# Altium schematic sheet ZYNQ_US_SOC_PL_GTX.SchDoc (part 1 of 3)
size 419 x 296 mm
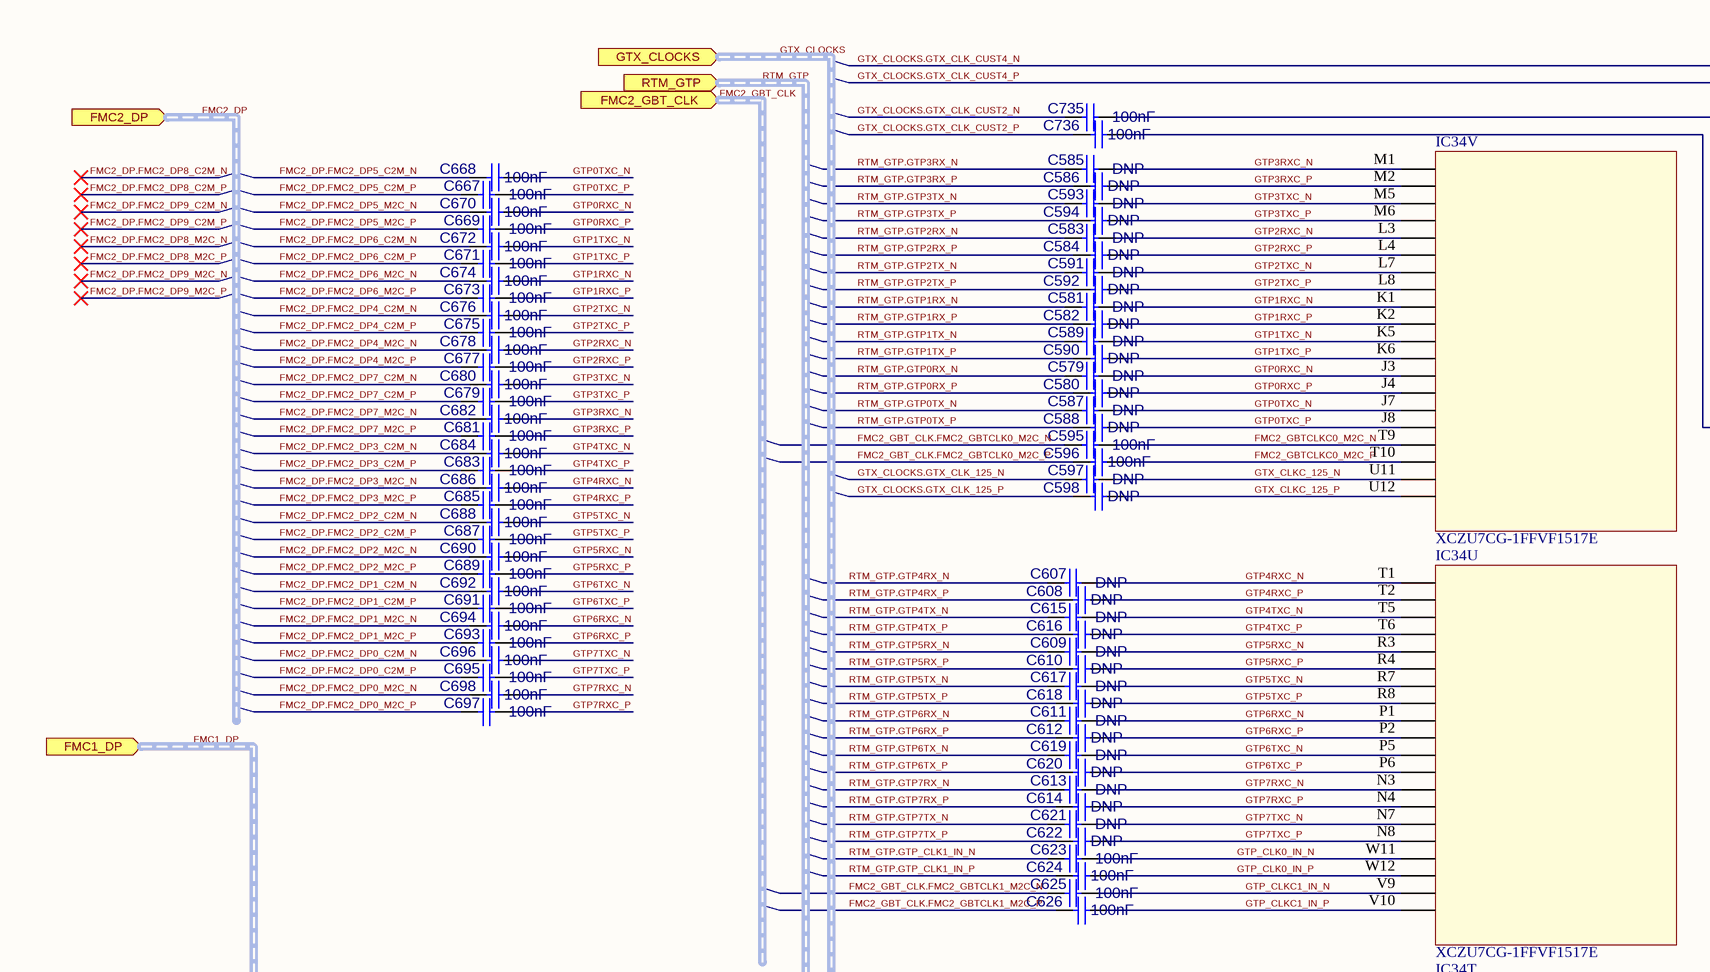
[diagram p0: ZYNQ_US_SOC_PL_GTX.SchDoc, top left]
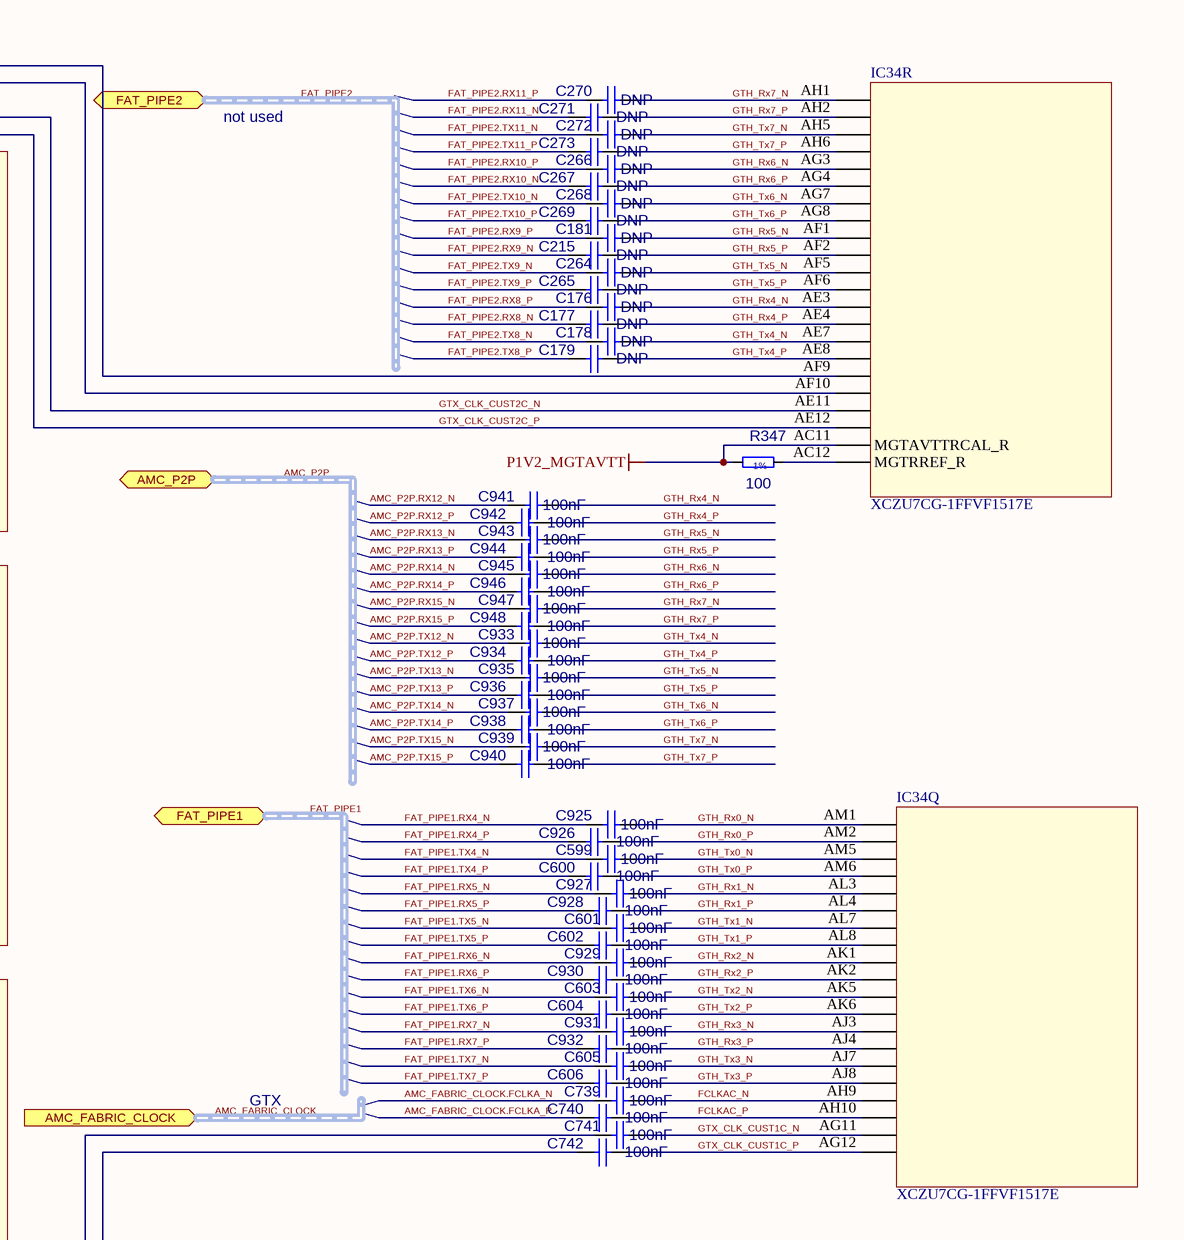
[diagram p1: ZYNQ_US_SOC_PL_GTX.SchDoc, top right]
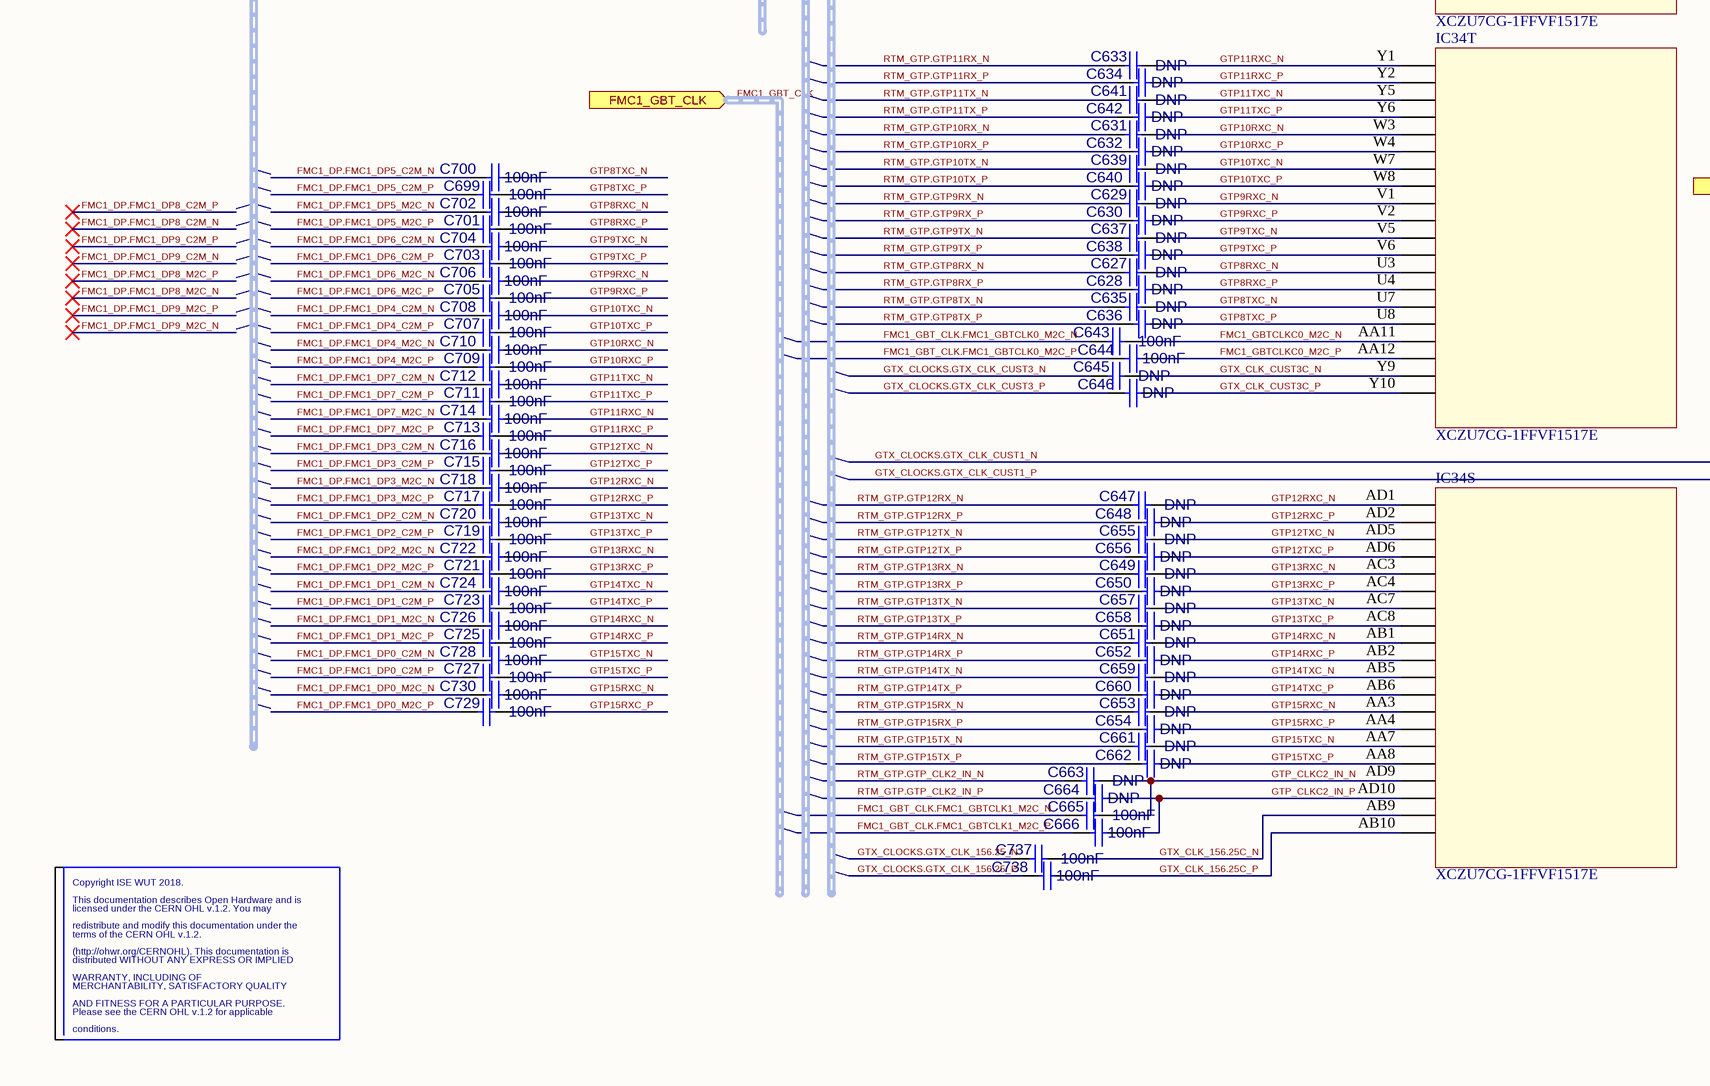
[diagram p2: ZYNQ_US_SOC_PL_GTX.SchDoc, bottom left]

## Parts
C176  value DNP  [CAPC0603X33N]  (hidden comment: Capacitor - non polarized CAPC0603X33N)
C177  value DNP  [CAPC0603X33N]  (hidden comment: Capacitor - non polarized CAPC0603X33N)
C178  value DNP  [CAPC0603X33N]  (hidden comment: Capacitor - non polarized CAPC0603X33N)
C179  value DNP  [CAPC0603X33N]  (hidden comment: Capacitor - non polarized CAPC0603X33N)
C181  value DNP  [CAPC0603X33N]  (hidden comment: Capacitor - non polarized CAPC0603X33N)
C215  value DNP  [CAPC0603X33N]  (hidden comment: Capacitor - non polarized CAPC0603X33N)
C264  value DNP  [CAPC0603X33N]  (hidden comment: Capacitor - non polarized CAPC0603X33N)
C265  value DNP  [CAPC0603X33N]  (hidden comment: Capacitor - non polarized CAPC0603X33N)
C266  value DNP  [CAPC0603X33N]  (hidden comment: Capacitor - non polarized CAPC0603X33N)
C267  value DNP  [CAPC0603X33N]  (hidden comment: Capacitor - non polarized CAPC0603X33N)
C268  value DNP  [CAPC0603X33N]  (hidden comment: Capacitor - non polarized CAPC0603X33N)
C269  value DNP  [CAPC0603X33N]  (hidden comment: Capacitor - non polarized CAPC0603X33N)
C270  value DNP  [CAPC0603X33N]  (hidden comment: Capacitor - non polarized CAPC0603X33N)
C271  value DNP  [CAPC0603X33N]  (hidden comment: Capacitor - non polarized CAPC0603X33N)
C272  value DNP  [CAPC0603X33N]  (hidden comment: Capacitor - non polarized CAPC0603X33N)
C273  value DNP  [CAPC0603X33N]  (hidden comment: Capacitor - non polarized CAPC0603X33N)
C579  value DNP  [CAPC0603X33N]  (hidden comment: Capacitor - non polarized CAPC0603X33N)
C580  value DNP  [CAPC0603X33N]  (hidden comment: Capacitor - non polarized CAPC0603X33N)
C581  value DNP  [CAPC0603X33N]  (hidden comment: Capacitor - non polarized CAPC0603X33N)
C582  value DNP  [CAPC0603X33N]  (hidden comment: Capacitor - non polarized CAPC0603X33N)
C583  value DNP  [CAPC0603X33N]  (hidden comment: Capacitor - non polarized CAPC0603X33N)
C584  value DNP  [CAPC0603X33N]  (hidden comment: Capacitor - non polarized CAPC0603X33N)
C585  value DNP  [CAPC0603X33N]  (hidden comment: Capacitor - non polarized CAPC0603X33N)
C586  value DNP  [CAPC0603X33N]  (hidden comment: Capacitor - non polarized CAPC0603X33N)
C587  value DNP  [CAPC0603X33N]  (hidden comment: Capacitor - non polarized CAPC0603X33N)
C588  value DNP  [CAPC0603X33N]  (hidden comment: Capacitor - non polarized CAPC0603X33N)
C589  value DNP  [CAPC0603X33N]  (hidden comment: Capacitor - non polarized CAPC0603X33N)
C590  value DNP  [CAPC0603X33N]  (hidden comment: Capacitor - non polarized CAPC0603X33N)
C591  value DNP  [CAPC0603X33N]  (hidden comment: Capacitor - non polarized CAPC0603X33N)
C592  value DNP  [CAPC0603X33N]  (hidden comment: Capacitor - non polarized CAPC0603X33N)
C593  value DNP  [CAPC0603X33N]  (hidden comment: Capacitor - non polarized CAPC0603X33N)
C594  value DNP  [CAPC0603X33N]  (hidden comment: Capacitor - non polarized CAPC0603X33N)
C595  value 100nF  [CAPC0603X33N]  (hidden comment: Capacitor - non polarized CAPC0603X33N)
C596  value 100nF  [CAPC0603X33N]  (hidden comment: Capacitor - non polarized CAPC0603X33N)
C597  value DNP  [CAPC0603X33N]  (hidden comment: Capacitor - non polarized CAPC0603X33N)
C598  value DNP  [CAPC0603X33N]  (hidden comment: Capacitor - non polarized CAPC0603X33N)
C599  value 100nF  [CAPC0603X33N]  (hidden comment: Capacitor - non polarized CAPC0603X33N)
C600  value 100nF  [CAPC0603X33N]  (hidden comment: Capacitor - non polarized CAPC0603X33N)
C601  value 100nF  [CAPC0603X33N]  (hidden comment: Capacitor - non polarized CAPC0603X33N)
C602  value 100nF  [CAPC0603X33N]  (hidden comment: Capacitor - non polarized CAPC0603X33N)
C603  value 100nF  [CAPC0603X33N]  (hidden comment: Capacitor - non polarized CAPC0603X33N)
C604  value 100nF  [CAPC0603X33N]  (hidden comment: Capacitor - non polarized CAPC0603X33N)
C605  value 100nF  [CAPC0603X33N]  (hidden comment: Capacitor - non polarized CAPC0603X33N)
C606  value 100nF  [CAPC0603X33N]  (hidden comment: Capacitor - non polarized CAPC0603X33N)
C607  value DNP  [CAPC0603X33N]  (hidden comment: Capacitor - non polarized CAPC0603X33N)
C608  value DNP  [CAPC0603X33N]  (hidden comment: Capacitor - non polarized CAPC0603X33N)
C609  value DNP  [CAPC0603X33N]  (hidden comment: Capacitor - non polarized CAPC0603X33N)
C610  value DNP  [CAPC0603X33N]  (hidden comment: Capacitor - non polarized CAPC0603X33N)
C611  value DNP  [CAPC0603X33N]  (hidden comment: Capacitor - non polarized CAPC0603X33N)
C612  value DNP  [CAPC0603X33N]  (hidden comment: Capacitor - non polarized CAPC0603X33N)
C613  value DNP  [CAPC0603X33N]  (hidden comment: Capacitor - non polarized CAPC0603X33N)
C614  value DNP  [CAPC0603X33N]  (hidden comment: Capacitor - non polarized CAPC0603X33N)
C615  value DNP  [CAPC0603X33N]  (hidden comment: Capacitor - non polarized CAPC0603X33N)
C616  value DNP  [CAPC0603X33N]  (hidden comment: Capacitor - non polarized CAPC0603X33N)
C617  value DNP  [CAPC0603X33N]  (hidden comment: Capacitor - non polarized CAPC0603X33N)
C618  value DNP  [CAPC0603X33N]  (hidden comment: Capacitor - non polarized CAPC0603X33N)
C619  value DNP  [CAPC0603X33N]  (hidden comment: Capacitor - non polarized CAPC0603X33N)
C620  value DNP  [CAPC0603X33N]  (hidden comment: Capacitor - non polarized CAPC0603X33N)
C621  value DNP  [CAPC0603X33N]  (hidden comment: Capacitor - non polarized CAPC0603X33N)
C622  value DNP  [CAPC0603X33N]  (hidden comment: Capacitor - non polarized CAPC0603X33N)
C623  value 100nF  [CAPC0603X33N]  (hidden comment: Capacitor - non polarized CAPC0603X33N)
C624  value 100nF  [CAPC0603X33N]  (hidden comment: Capacitor - non polarized CAPC0603X33N)
C625  value 100nF  [CAPC0603X33N]  (hidden comment: Capacitor - non polarized CAPC0603X33N)
C626  value 100nF  [CAPC0603X33N]  (hidden comment: Capacitor - non polarized CAPC0603X33N)
C627  value DNP  [CAPC0603X33N]  (hidden comment: Capacitor - non polarized CAPC0603X33N)
C628  value DNP  [CAPC0603X33N]  (hidden comment: Capacitor - non polarized CAPC0603X33N)
C629  value DNP  [CAPC0603X33N]  (hidden comment: Capacitor - non polarized CAPC0603X33N)
C630  value DNP  [CAPC0603X33N]  (hidden comment: Capacitor - non polarized CAPC0603X33N)
C631  value DNP  [CAPC0603X33N]  (hidden comment: Capacitor - non polarized CAPC0603X33N)
C632  value DNP  [CAPC0603X33N]  (hidden comment: Capacitor - non polarized CAPC0603X33N)
C633  value DNP  [CAPC0603X33N]  (hidden comment: Capacitor - non polarized CAPC0603X33N)
C634  value DNP  [CAPC0603X33N]  (hidden comment: Capacitor - non polarized CAPC0603X33N)
C635  value DNP  [CAPC0603X33N]  (hidden comment: Capacitor - non polarized CAPC0603X33N)
C636  value DNP  [CAPC0603X33N]  (hidden comment: Capacitor - non polarized CAPC0603X33N)
C637  value DNP  [CAPC0603X33N]  (hidden comment: Capacitor - non polarized CAPC0603X33N)
C638  value DNP  [CAPC0603X33N]  (hidden comment: Capacitor - non polarized CAPC0603X33N)
C639  value DNP  [CAPC0603X33N]  (hidden comment: Capacitor - non polarized CAPC0603X33N)
C640  value DNP  [CAPC0603X33N]  (hidden comment: Capacitor - non polarized CAPC0603X33N)
C641  value DNP  [CAPC0603X33N]  (hidden comment: Capacitor - non polarized CAPC0603X33N)
C642  value DNP  [CAPC0603X33N]  (hidden comment: Capacitor - non polarized CAPC0603X33N)
C643  value 100nF  [CAPC0603X33N]  (hidden comment: Capacitor - non polarized CAPC0603X33N)
C644  value 100nF  [CAPC0603X33N]  (hidden comment: Capacitor - non polarized CAPC0603X33N)
C645  value DNP  [CAPC0603X33N]  (hidden comment: Capacitor - non polarized CAPC0603X33N)
C646  value DNP  [CAPC0603X33N]  (hidden comment: Capacitor - non polarized CAPC0603X33N)
C647  value DNP  [CAPC0603X33N]  (hidden comment: Capacitor - non polarized CAPC0603X33N)
C648  value DNP  [CAPC0603X33N]  (hidden comment: Capacitor - non polarized CAPC0603X33N)
C649  value DNP  [CAPC0603X33N]  (hidden comment: Capacitor - non polarized CAPC0603X33N)
C650  value DNP  [CAPC0603X33N]  (hidden comment: Capacitor - non polarized CAPC0603X33N)
C651  value DNP  [CAPC0603X33N]  (hidden comment: Capacitor - non polarized CAPC0603X33N)
C652  value DNP  [CAPC0603X33N]  (hidden comment: Capacitor - non polarized CAPC0603X33N)
C653  value DNP  [CAPC0603X33N]  (hidden comment: Capacitor - non polarized CAPC0603X33N)
C654  value DNP  [CAPC0603X33N]  (hidden comment: Capacitor - non polarized CAPC0603X33N)
C655  value DNP  [CAPC0603X33N]  (hidden comment: Capacitor - non polarized CAPC0603X33N)
C656  value DNP  [CAPC0603X33N]  (hidden comment: Capacitor - non polarized CAPC0603X33N)
C657  value DNP  [CAPC0603X33N]  (hidden comment: Capacitor - non polarized CAPC0603X33N)
C658  value DNP  [CAPC0603X33N]  (hidden comment: Capacitor - non polarized CAPC0603X33N)
C659  value DNP  [CAPC0603X33N]  (hidden comment: Capacitor - non polarized CAPC0603X33N)
C660  value DNP  [CAPC0603X33N]  (hidden comment: Capacitor - non polarized CAPC0603X33N)
C661  value DNP  [CAPC0603X33N]  (hidden comment: Capacitor - non polarized CAPC0603X33N)
C662  value DNP  [CAPC0603X33N]  (hidden comment: Capacitor - non polarized CAPC0603X33N)
C663  value DNP  [CAPC0603X33N]  (hidden comment: Capacitor - non polarized CAPC0603X33N)
C664  value DNP  [CAPC0603X33N]  (hidden comment: Capacitor - non polarized CAPC0603X33N)
C665  value 100nF  [CAPC0603X33N]  (hidden comment: Capacitor - non polarized CAPC0603X33N)
C666  value 100nF  [CAPC0603X33N]  (hidden comment: Capacitor - non polarized CAPC0603X33N)
C667  value 100nF  [CAPC0603X33N]  (hidden comment: Capacitor - non polarized CAPC0603X33N)
C668  value 100nF  [CAPC0603X33N]  (hidden comment: Capacitor - non polarized CAPC0603X33N)
C669  value 100nF  [CAPC0603X33N]  (hidden comment: Capacitor - non polarized CAPC0603X33N)
C670  value 100nF  [CAPC0603X33N]  (hidden comment: Capacitor - non polarized CAPC0603X33N)
C671  value 100nF  [CAPC0603X33N]  (hidden comment: Capacitor - non polarized CAPC0603X33N)
C672  value 100nF  [CAPC0603X33N]  (hidden comment: Capacitor - non polarized CAPC0603X33N)
C673  value 100nF  [CAPC0603X33N]  (hidden comment: Capacitor - non polarized CAPC0603X33N)
C674  value 100nF  [CAPC0603X33N]  (hidden comment: Capacitor - non polarized CAPC0603X33N)
C675  value 100nF  [CAPC0603X33N]  (hidden comment: Capacitor - non polarized CAPC0603X33N)
C676  value 100nF  [CAPC0603X33N]  (hidden comment: Capacitor - non polarized CAPC0603X33N)
C677  value 100nF  [CAPC0603X33N]  (hidden comment: Capacitor - non polarized CAPC0603X33N)
C678  value 100nF  [CAPC0603X33N]  (hidden comment: Capacitor - non polarized CAPC0603X33N)
C679  value 100nF  [CAPC0603X33N]  (hidden comment: Capacitor - non polarized CAPC0603X33N)
C680  value 100nF  [CAPC0603X33N]  (hidden comment: Capacitor - non polarized CAPC0603X33N)
C681  value 100nF  [CAPC0603X33N]  (hidden comment: Capacitor - non polarized CAPC0603X33N)
C682  value 100nF  [CAPC0603X33N]  (hidden comment: Capacitor - non polarized CAPC0603X33N)
C683  value 100nF  [CAPC0603X33N]  (hidden comment: Capacitor - non polarized CAPC0603X33N)
C684  value 100nF  [CAPC0603X33N]  (hidden comment: Capacitor - non polarized CAPC0603X33N)
C685  value 100nF  [CAPC0603X33N]  (hidden comment: Capacitor - non polarized CAPC0603X33N)
C686  value 100nF  [CAPC0603X33N]  (hidden comment: Capacitor - non polarized CAPC0603X33N)
C687  value 100nF  [CAPC0603X33N]  (hidden comment: Capacitor - non polarized CAPC0603X33N)
C688  value 100nF  [CAPC0603X33N]  (hidden comment: Capacitor - non polarized CAPC0603X33N)
C689  value 100nF  [CAPC0603X33N]  (hidden comment: Capacitor - non polarized CAPC0603X33N)
C690  value 100nF  [CAPC0603X33N]  (hidden comment: Capacitor - non polarized CAPC0603X33N)
C691  value 100nF  [CAPC0603X33N]  (hidden comment: Capacitor - non polarized CAPC0603X33N)
C692  value 100nF  [CAPC0603X33N]  (hidden comment: Capacitor - non polarized CAPC0603X33N)
C693  value 100nF  [CAPC0603X33N]  (hidden comment: Capacitor - non polarized CAPC0603X33N)
C694  value 100nF  [CAPC0603X33N]  (hidden comment: Capacitor - non polarized CAPC0603X33N)
C695  value 100nF  [CAPC0603X33N]  (hidden comment: Capacitor - non polarized CAPC0603X33N)
C696  value 100nF  [CAPC0603X33N]  (hidden comment: Capacitor - non polarized CAPC0603X33N)
C697  value 100nF  [CAPC0603X33N]  (hidden comment: Capacitor - non polarized CAPC0603X33N)
C698  value 100nF  [CAPC0603X33N]  (hidden comment: Capacitor - non polarized CAPC0603X33N)
C699  value 100nF  [CAPC0603X33N]  (hidden comment: Capacitor - non polarized CAPC0603X33N)
C700  value 100nF  [CAPC0603X33N]  (hidden comment: Capacitor - non polarized CAPC0603X33N)
C701  value 100nF  [CAPC0603X33N]  (hidden comment: Capacitor - non polarized CAPC0603X33N)
C702  value 100nF  [CAPC0603X33N]  (hidden comment: Capacitor - non polarized CAPC0603X33N)
C703  value 100nF  [CAPC0603X33N]  (hidden comment: Capacitor - non polarized CAPC0603X33N)
C704  value 100nF  [CAPC0603X33N]  (hidden comment: Capacitor - non polarized CAPC0603X33N)
C705  value 100nF  [CAPC0603X33N]  (hidden comment: Capacitor - non polarized CAPC0603X33N)
C706  value 100nF  [CAPC0603X33N]  (hidden comment: Capacitor - non polarized CAPC0603X33N)
C707  value 100nF  [CAPC0603X33N]  (hidden comment: Capacitor - non polarized CAPC0603X33N)
C708  value 100nF  [CAPC0603X33N]  (hidden comment: Capacitor - non polarized CAPC0603X33N)
C709  value 100nF  [CAPC0603X33N]  (hidden comment: Capacitor - non polarized CAPC0603X33N)
C710  value 100nF  [CAPC0603X33N]  (hidden comment: Capacitor - non polarized CAPC0603X33N)
C711  value 100nF  [CAPC0603X33N]  (hidden comment: Capacitor - non polarized CAPC0603X33N)
C712  value 100nF  [CAPC0603X33N]  (hidden comment: Capacitor - non polarized CAPC0603X33N)
C713  value 100nF  [CAPC0603X33N]  (hidden comment: Capacitor - non polarized CAPC0603X33N)
C714  value 100nF  [CAPC0603X33N]  (hidden comment: Capacitor - non polarized CAPC0603X33N)
C715  value 100nF  [CAPC0603X33N]  (hidden comment: Capacitor - non polarized CAPC0603X33N)
C716  value 100nF  [CAPC0603X33N]  (hidden comment: Capacitor - non polarized CAPC0603X33N)
C717  value 100nF  [CAPC0603X33N]  (hidden comment: Capacitor - non polarized CAPC0603X33N)
C718  value 100nF  [CAPC0603X33N]  (hidden comment: Capacitor - non polarized CAPC0603X33N)
C719  value 100nF  [CAPC0603X33N]  (hidden comment: Capacitor - non polarized CAPC0603X33N)
C720  value 100nF  [CAPC0603X33N]  (hidden comment: Capacitor - non polarized CAPC0603X33N)
C721  value 100nF  [CAPC0603X33N]  (hidden comment: Capacitor - non polarized CAPC0603X33N)
C722  value 100nF  [CAPC0603X33N]  (hidden comment: Capacitor - non polarized CAPC0603X33N)
C723  value 100nF  [CAPC0603X33N]  (hidden comment: Capacitor - non polarized CAPC0603X33N)
C724  value 100nF  [CAPC0603X33N]  (hidden comment: Capacitor - non polarized CAPC0603X33N)
C725  value 100nF  [CAPC0603X33N]  (hidden comment: Capacitor - non polarized CAPC0603X33N)
C726  value 100nF  [CAPC0603X33N]  (hidden comment: Capacitor - non polarized CAPC0603X33N)
C727  value 100nF  [CAPC0603X33N]  (hidden comment: Capacitor - non polarized CAPC0603X33N)
C728  value 100nF  [CAPC0603X33N]  (hidden comment: Capacitor - non polarized CAPC0603X33N)
C729  value 100nF  [CAPC0603X33N]  (hidden comment: Capacitor - non polarized CAPC0603X33N)
C730  value 100nF  [CAPC0603X33N]  (hidden comment: Capacitor - non polarized CAPC0603X33N)
C735  value 100nF  [CAPC0603X33N]  (hidden comment: Capacitor - non polarized CAPC0603X33N)
C736  value 100nF  [CAPC0603X33N]  (hidden comment: Capacitor - non polarized CAPC0603X33N)
C737  value 100nF  [CAPC0603X33N]  (hidden comment: Capacitor - non polarized CAPC0603X33N)
C738  value 100nF  [CAPC0603X33N]  (hidden comment: Capacitor - non polarized CAPC0603X33N)
C739  value 100nF  [CAPC0603X33N]  (hidden comment: Capacitor - non polarized CAPC0603X33N)
C740  value 100nF  [CAPC0603X33N]  (hidden comment: Capacitor - non polarized CAPC0603X33N)
C741  value 100nF  [CAPC0603X33N]  (hidden comment: Capacitor - non polarized CAPC0603X33N)
C742  value 100nF  [CAPC0603X33N]  (hidden comment: Capacitor - non polarized CAPC0603X33N)
C925  value 100nF  [CAPC0603X33N]  (hidden comment: Capacitor - non polarized CAPC0603X33N)
C926  value 100nF  [CAPC0603X33N]  (hidden comment: Capacitor - non polarized CAPC0603X33N)
C927  value 100nF  [CAPC0603X33N]  (hidden comment: Capacitor - non polarized CAPC0603X33N)
C928  value 100nF  [CAPC0603X33N]  (hidden comment: Capacitor - non polarized CAPC0603X33N)
C929  value 100nF  [CAPC0603X33N]  (hidden comment: Capacitor - non polarized CAPC0603X33N)
C930  value 100nF  [CAPC0603X33N]  (hidden comment: Capacitor - non polarized CAPC0603X33N)
C931  value 100nF  [CAPC0603X33N]  (hidden comment: Capacitor - non polarized CAPC0603X33N)
C932  value 100nF  [CAPC0603X33N]  (hidden comment: Capacitor - non polarized CAPC0603X33N)
C933  value 100nF  [CAPC0603X33N]  (hidden comment: Capacitor - non polarized CAPC0603X33N)
C934  value 100nF  [CAPC0603X33N]  (hidden comment: Capacitor - non polarized CAPC0603X33N)
C935  value 100nF  [CAPC0603X33N]  (hidden comment: Capacitor - non polarized CAPC0603X33N)
C936  value 100nF  [CAPC0603X33N]  (hidden comment: Capacitor - non polarized CAPC0603X33N)
C937  value 100nF  [CAPC0603X33N]  (hidden comment: Capacitor - non polarized CAPC0603X33N)
C938  value 100nF  [CAPC0603X33N]  (hidden comment: Capacitor - non polarized CAPC0603X33N)
C939  value 100nF  [CAPC0603X33N]  (hidden comment: Capacitor - non polarized CAPC0603X33N)
C940  value 100nF  [CAPC0603X33N]  (hidden comment: Capacitor - non polarized CAPC0603X33N)
C941  value 100nF  [CAPC0603X33N]  (hidden comment: Capacitor - non polarized CAPC0603X33N)
C942  value 100nF  [CAPC0603X33N]  (hidden comment: Capacitor - non polarized CAPC0603X33N)
C943  value 100nF  [CAPC0603X33N]  (hidden comment: Capacitor - non polarized CAPC0603X33N)
C944  value 100nF  [CAPC0603X33N]  (hidden comment: Capacitor - non polarized CAPC0603X33N)
C945  value 100nF  [CAPC0603X33N]  (hidden comment: Capacitor - non polarized CAPC0603X33N)
C946  value 100nF  [CAPC0603X33N]  (hidden comment: Capacitor - non polarized CAPC0603X33N)
C947  value 100nF  [CAPC0603X33N]  (hidden comment: Capacitor - non polarized CAPC0603X33N)
C948  value 100nF  [CAPC0603X33N]  (hidden comment: Capacitor - non polarized CAPC0603X33N)
IC34  XCZU7CG-1FFVF1517E  (parts Q,R,S,T,U,V of 26)
R347  value 100  (hidden comment: Resistor - 1% RESC1005X40N)

## Ports
AMC_FABRIC_CLOCK (in, harness AMC_FABRIC_CLOCK), AMC_P2P (bidir, harness AMC_P2P), FAT_PIPE1 (bidir, harness FAT_PIPE1), FAT_PIPE2 (bidir, harness FAT_PIPE2), FMC1_DP (in, harness FMC1_DP), FMC1_GBT_CLK (in, harness FMC1_GBT_CLK), FMC2_DP (in, harness FMC2_DP), FMC2_GBT_CLK (in, harness FMC2_GBT_CLK), GTX_CLOCKS (in, harness GTX_CLOCKS), RTM_GTP (in, harness RTM_GTP)

## Nets
P1V2_MGTAVTT: IC34.AC11(MGTAVTTRCAL_R) R347.1
AMC_FABRIC_CLOCK.FCLKA_N: C739.1
AMC_FABRIC_CLOCK.FCLKA_P: C740.1
AMC_P2P.RX12_N: C941.1
AMC_P2P.RX12_P: C942.1
AMC_P2P.RX13_N: C943.1
AMC_P2P.RX13_P: C944.1
AMC_P2P.RX14_N: C945.1
AMC_P2P.RX14_P: C946.1
AMC_P2P.RX15_N: C947.1
AMC_P2P.RX15_P: C948.1
AMC_P2P.TX12_N: C933.1
AMC_P2P.TX12_P: C934.1
AMC_P2P.TX13_N: C935.1
AMC_P2P.TX13_P: C936.1
AMC_P2P.TX14_N: C937.1
AMC_P2P.TX14_P: C938.1
AMC_P2P.TX15_N: C939.1
AMC_P2P.TX15_P: C940.1
FAT_PIPE1.RX4_N: C925.1
FAT_PIPE1.RX4_P: C926.1
FAT_PIPE1.RX5_N: C927.1
FAT_PIPE1.RX5_P: C928.1
FAT_PIPE1.RX6_N: C929.1
FAT_PIPE1.RX6_P: C930.1
FAT_PIPE1.RX7_N: C931.1
FAT_PIPE1.RX7_P: C932.1
FAT_PIPE1.TX4_N: C599.1
FAT_PIPE1.TX4_P: C600.1
FAT_PIPE1.TX5_N: C601.1
FAT_PIPE1.TX5_P: C602.1
FAT_PIPE1.TX6_N: C603.1
FAT_PIPE1.TX6_P: C604.1
FAT_PIPE1.TX7_N: C605.1
FAT_PIPE1.TX7_P: C606.1
FAT_PIPE2.RX8_N: C177.1
FAT_PIPE2.RX8_P: C176.1
FAT_PIPE2.RX9_N: C215.1
FAT_PIPE2.RX9_P: C181.1
FAT_PIPE2.RX10_N: C267.1
FAT_PIPE2.RX10_P: C266.1
FAT_PIPE2.RX11_N: C271.1
FAT_PIPE2.RX11_P: C270.1
FAT_PIPE2.TX8_N: C178.1
FAT_PIPE2.TX8_P: C179.1
FAT_PIPE2.TX9_N: C264.1
FAT_PIPE2.TX9_P: C265.1
FAT_PIPE2.TX10_N: C268.1
FAT_PIPE2.TX10_P: C269.1
FAT_PIPE2.TX11_N: C272.1
FAT_PIPE2.TX11_P: C273.1
FCLKAC_N: C739.2 IC34.AH9(GTHE4_COMMON_X0Y0_3)
FCLKAC_P: C740.2 IC34.AH10(GTHE4_COMMON_X0Y0_2)
FMC1_DP.FMC1_DP0_C2M_N: C728.1
FMC1_DP.FMC1_DP0_C2M_P: C727.1
FMC1_DP.FMC1_DP0_M2C_N: C730.1
FMC1_DP.FMC1_DP0_M2C_P: C729.1
FMC1_DP.FMC1_DP1_C2M_N: C724.1
FMC1_DP.FMC1_DP1_C2M_P: C723.1
FMC1_DP.FMC1_DP1_M2C_N: C726.1
FMC1_DP.FMC1_DP1_M2C_P: C725.1
FMC1_DP.FMC1_DP2_C2M_N: C720.1
FMC1_DP.FMC1_DP2_C2M_P: C719.1
FMC1_DP.FMC1_DP2_M2C_N: C722.1
FMC1_DP.FMC1_DP2_M2C_P: C721.1
FMC1_DP.FMC1_DP3_C2M_N: C716.1
FMC1_DP.FMC1_DP3_C2M_P: C715.1
FMC1_DP.FMC1_DP3_M2C_N: C718.1
FMC1_DP.FMC1_DP3_M2C_P: C717.1
FMC1_DP.FMC1_DP4_C2M_N: C708.1
FMC1_DP.FMC1_DP4_C2M_P: C707.1
FMC1_DP.FMC1_DP4_M2C_N: C710.1
FMC1_DP.FMC1_DP4_M2C_P: C709.1
FMC1_DP.FMC1_DP5_C2M_N: C700.1
FMC1_DP.FMC1_DP5_C2M_P: C699.1
FMC1_DP.FMC1_DP5_M2C_N: C702.1
FMC1_DP.FMC1_DP5_M2C_P: C701.1
FMC1_DP.FMC1_DP6_C2M_N: C704.1
FMC1_DP.FMC1_DP6_C2M_P: C703.1
FMC1_DP.FMC1_DP6_M2C_N: C706.1
FMC1_DP.FMC1_DP6_M2C_P: C705.1
FMC1_DP.FMC1_DP7_C2M_N: C712.1
FMC1_DP.FMC1_DP7_C2M_P: C711.1
FMC1_DP.FMC1_DP7_M2C_N: C714.1
FMC1_DP.FMC1_DP7_M2C_P: C713.1
FMC1_GBT_CLK.FMC1_GBTCLK0_M2C_N: C643.1
FMC1_GBT_CLK.FMC1_GBTCLK0_M2C_P: C644.1
FMC1_GBT_CLK.FMC1_GBTCLK1_M2C_N: C665.1
FMC1_GBT_CLK.FMC1_GBTCLK1_M2C_P: C666.1
FMC1_GBTCLKC0_M2C_N: C643.2 IC34.AA11(GTHE4_COMMON_X0Y3)
FMC1_GBTCLKC0_M2C_P: C644.2 IC34.AA12(GTHE4_COMMON_X0Y3_1)
FMC2_DP.FMC2_DP0_C2M_N: C696.1
FMC2_DP.FMC2_DP0_C2M_P: C695.1
FMC2_DP.FMC2_DP0_M2C_N: C698.1
FMC2_DP.FMC2_DP0_M2C_P: C697.1
FMC2_DP.FMC2_DP1_C2M_N: C692.1
FMC2_DP.FMC2_DP1_C2M_P: C691.1
FMC2_DP.FMC2_DP1_M2C_N: C694.1
FMC2_DP.FMC2_DP1_M2C_P: C693.1
FMC2_DP.FMC2_DP2_C2M_N: C688.1
FMC2_DP.FMC2_DP2_C2M_P: C687.1
FMC2_DP.FMC2_DP2_M2C_N: C690.1
FMC2_DP.FMC2_DP2_M2C_P: C689.1
FMC2_DP.FMC2_DP3_C2M_N: C684.1
FMC2_DP.FMC2_DP3_C2M_P: C683.1
FMC2_DP.FMC2_DP3_M2C_N: C686.1
FMC2_DP.FMC2_DP3_M2C_P: C685.1
FMC2_DP.FMC2_DP4_C2M_N: C676.1
FMC2_DP.FMC2_DP4_C2M_P: C675.1
FMC2_DP.FMC2_DP4_M2C_N: C678.1
FMC2_DP.FMC2_DP4_M2C_P: C677.1
FMC2_DP.FMC2_DP5_C2M_N: C668.1
FMC2_DP.FMC2_DP5_C2M_P: C667.1
FMC2_DP.FMC2_DP5_M2C_N: C670.1
FMC2_DP.FMC2_DP5_M2C_P: C669.1
FMC2_DP.FMC2_DP6_C2M_N: C672.1
FMC2_DP.FMC2_DP6_C2M_P: C671.1
FMC2_DP.FMC2_DP6_M2C_N: C674.1
FMC2_DP.FMC2_DP6_M2C_P: C673.1
FMC2_DP.FMC2_DP7_C2M_N: C680.1
FMC2_DP.FMC2_DP7_C2M_P: C679.1
FMC2_DP.FMC2_DP7_M2C_N: C682.1
FMC2_DP.FMC2_DP7_M2C_P: C681.1
FMC2_GBT_CLK.FMC2_GBTCLK0_M2C_N: C595.1
FMC2_GBT_CLK.FMC2_GBTCLK0_M2C_P: C596.1
FMC2_GBT_CLK.FMC2_GBTCLK1_M2C_N: C625.1
FMC2_GBT_CLK.FMC2_GBTCLK1_M2C_P: C626.1
FMC2_GBTCLKC0_M2C_N: C595.2 IC34.T9(GTHE4_COMMON_X0Y5_1)
FMC2_GBTCLKC0_M2C_P: C596.2 IC34.T10(GTHE4_COMMON_X0Y5)
GTH_Rx0_N: C925.2 IC34.AM1(GTHE4_CHANNEL_X0Y0)
GTH_Rx0_P: C926.2 IC34.AM2(GTHE4_CHANNEL_X0Y0_1)
GTH_Rx1_N: C927.2 IC34.AL3(GTHE4_CHANNEL_X0Y1)
GTH_Rx1_P: C928.2 IC34.AL4(GTHE4_CHANNEL_X0Y1_1)
GTH_Rx2_N: C929.2 IC34.AK1(GTHE4_CHANNEL_X0Y2)
GTH_Rx2_P: C930.2 IC34.AK2(GTHE4_CHANNEL_X0Y2_1)
GTH_Rx3_N: C931.2 IC34.AJ3(GTHE4_CHANNEL_X0Y3)
GTH_Rx3_P: C932.2 IC34.AJ4(GTHE4_CHANNEL_X0Y3_1)
GTH_Rx4_N: C176.2 C941.2 IC34.AE3(GTHE4_CHANNEL_X0Y7)
GTH_Rx4_P: C177.2 C942.2 IC34.AE4(GTHE4_CHANNEL_X0Y7_1)
GTH_Rx5_N: C181.2 C943.2 IC34.AF1(GTHE4_CHANNEL_X0Y6)
GTH_Rx5_P: C215.2 C944.2 IC34.AF2(GTHE4_CHANNEL_X0Y6_1)
GTH_Rx6_N: C266.2 C945.2 IC34.AG3(GTHE4_CHANNEL_X0Y5)
GTH_Rx6_P: C267.2 C946.2 IC34.AG4(GTHE4_CHANNEL_X0Y5_1)
GTH_Rx7_N: C270.2 C947.2 IC34.AH1(GTHE4_CHANNEL_X0Y4)
GTH_Rx7_P: C271.2 C948.2 IC34.AH2(GTHE4_CHANNEL_X0Y4_1)
GTH_Tx0_N: C599.2 IC34.AM5(GTHE4_CHANNEL_X0Y0_2)
GTH_Tx0_P: C600.2 IC34.AM6(GTHE4_CHANNEL_X0Y0_3)
GTH_Tx1_N: C601.2 IC34.AL7(GTHE4_CHANNEL_X0Y1_2)
GTH_Tx1_P: C602.2 IC34.AL8(GTHE4_CHANNEL_X0Y1_3)
GTH_Tx2_N: C603.2 IC34.AK5(GTHE4_CHANNEL_X0Y2_2)
GTH_Tx2_P: C604.2 IC34.AK6(GTHE4_CHANNEL_X0Y2_3)
GTH_Tx3_N: C605.2 IC34.AJ7(GTHE4_CHANNEL_X0Y3_2)
GTH_Tx3_P: C606.2 IC34.AJ8(GTHE4_CHANNEL_X0Y3_3)
GTH_Tx4_N: C178.2 C933.2 IC34.AE7(GTHE4_CHANNEL_X0Y7_2)
GTH_Tx4_P: C179.2 C934.2 IC34.AE8(GTHE4_CHANNEL_X0Y7_3)
GTH_Tx5_N: C264.2 C935.2 IC34.AF5(GTHE4_CHANNEL_X0Y6_2)
GTH_Tx5_P: C265.2 C936.2 IC34.AF6(GTHE4_CHANNEL_X0Y6_3)
GTH_Tx6_N: C268.2 C937.2 IC34.AG7(GTHE4_CHANNEL_X0Y5_2)
GTH_Tx6_P: C269.2 C938.2 IC34.AG8(GTHE4_CHANNEL_X0Y5_3)
GTH_Tx7_N: C272.2 C939.2 IC34.AH5(GTHE4_CHANNEL_X0Y4_2)
GTH_Tx7_P: C273.2 C940.2 IC34.AH6(GTHE4_CHANNEL_X0Y4_3)
GTP0RXC_N: C579.2 C670.2 IC34.J3(GTHE4_CHANNEL_X0Y23)
GTP0RXC_P: C580.2 C669.2 IC34.J4(GTHE4_CHANNEL_X0Y23_1)
GTP0TXC_N: C587.2 C668.2 IC34.J7(GTHE4_CHANNEL_X0Y23_2)
GTP0TXC_P: C588.2 C667.2 IC34.J8(GTHE4_CHANNEL_X0Y23_3)
GTP1RXC_N: C581.2 C674.2 IC34.K1(GTHE4_CHANNEL_X0Y22)
GTP1RXC_P: C582.2 C673.2 IC34.K2(GTHE4_CHANNEL_X0Y22_1)
GTP1TXC_N: C589.2 C672.2 IC34.K5(GTHE4_CHANNEL_X0Y22_2)
GTP1TXC_P: C590.2 C671.2 IC34.K6(GTHE4_CHANNEL_X0Y22_3)
GTP2RXC_N: C583.2 C678.2 IC34.L3(GTHE4_CHANNEL_X0Y21)
GTP2RXC_P: C584.2 C677.2 IC34.L4(GTHE4_CHANNEL_X0Y21_1)
GTP2TXC_N: C591.2 C676.2 IC34.L7(GTHE4_CHANNEL_X0Y21_2)
GTP2TXC_P: C592.2 C675.2 IC34.L8(GTHE4_CHANNEL_X0Y21_3)
GTP3RXC_N: C585.2 C682.2 IC34.M1(GTHE4_CHANNEL_X0Y20)
GTP3RXC_P: C586.2 C681.2 IC34.M2(GTHE4_CHANNEL_X0Y20_1)
GTP3TXC_N: C593.2 C680.2 IC34.M5(GTHE4_CHANNEL_X0Y20_2)
GTP3TXC_P: C594.2 C679.2 IC34.M6(GTHE4_CHANNEL_X0Y20_3)
GTP4RXC_N: C607.2 C686.2 IC34.T1(GTHE4_CHANNEL_X0Y16)
GTP4RXC_P: C608.2 C685.2 IC34.T2(GTHE4_CHANNEL_X0Y16_1)
GTP4TXC_N: C615.2 C684.2 IC34.T5(GTHE4_CHANNEL_X0Y16_2)
GTP4TXC_P: C616.2 C683.2 IC34.T6(GTHE4_CHANNEL_X0Y16_3)
GTP5RXC_N: C609.2 C690.2 IC34.R3(GTHE4_CHANNEL_X0Y17)
GTP5RXC_P: C610.2 C689.2 IC34.R4(GTHE4_CHANNEL_X0Y17_1)
GTP5TXC_N: C617.2 C688.2 IC34.R7(GTHE4_CHANNEL_X0Y17_2)
GTP5TXC_P: C618.2 C687.2 IC34.R8(GTHE4_CHANNEL_X0Y17_3)
GTP6RXC_N: C611.2 C694.2 IC34.P1(GTHE4_CHANNEL_X0Y18)
GTP6RXC_P: C612.2 C693.2 IC34.P2(GTHE4_CHANNEL_X0Y18_1)
GTP6TXC_N: C619.2 C692.2 IC34.P5(GTHE4_CHANNEL_X0Y18_2)
GTP6TXC_P: C620.2 C691.2 IC34.P6(GTHE4_CHANNEL_X0Y18_3)
GTP7RXC_N: C613.2 C698.2 IC34.N3(GTHE4_CHANNEL_X0Y19)
GTP7RXC_P: C614.2 C697.2 IC34.N4(GTHE4_CHANNEL_X0Y19_1)
GTP7TXC_N: C621.2 C696.2 IC34.N7(GTHE4_CHANNEL_X0Y19_2)
GTP7TXC_P: C622.2 C695.2 IC34.N8(GTHE4_CHANNEL_X0Y19_3)
GTP8RXC_N: C627.2 C702.2 IC34.U3(GTHE4_CHANNEL_X0Y15)
GTP8RXC_P: C628.2 C701.2 IC34.U4(GTHE4_CHANNEL_X0Y15_1)
GTP8TXC_N: C635.2 C700.2 IC34.U7(GTHE4_CHANNEL_X0Y15_2)
GTP8TXC_P: C636.2 C699.2 IC34.U8(GTHE4_CHANNEL_X0Y15_3)
GTP9RXC_N: C629.2 C706.2 IC34.V1(GTHE4_CHANNEL_X0Y14)
GTP9RXC_P: C630.2 C705.2 IC34.V2(GTHE4_CHANNEL_X0Y14_1)
GTP9TXC_N: C637.2 C704.2 IC34.V5(GTHE4_CHANNEL_X0Y14_2)
GTP9TXC_P: C638.2 C703.2 IC34.V6(GTHE4_CHANNEL_X0Y14_3)
GTP10RXC_N: C631.2 C710.2 IC34.W3(GTHE4_CHANNEL_X0Y13)
GTP10RXC_P: C632.2 C709.2 IC34.W4(GTHE4_CHANNEL_X0Y13_1)
GTP10TXC_N: C639.2 C708.2 IC34.W7(GTHE4_CHANNEL_X0Y13_2)
GTP10TXC_P: C640.2 C707.2 IC34.W8(GTHE4_CHANNEL_X0Y13_3)
GTP11RXC_N: C633.2 C714.2 IC34.Y1(GTHE4_CHANNEL_X0Y12)
GTP11RXC_P: C634.2 C713.2 IC34.Y2(GTHE4_CHANNEL_X0Y12_1)
GTP11TXC_N: C641.2 C712.2 IC34.Y5(GTHE4_CHANNEL_X0Y12_2)
GTP11TXC_P: C642.2 C711.2 IC34.Y6(GTHE4_CHANNEL_X0Y12_3)
GTP12RXC_N: C647.2 C718.2 IC34.AD1(GTHE4_CHANNEL_X0Y8)
GTP12RXC_P: C648.2 C717.2 IC34.AD2(GTHE4_CHANNEL_X0Y8_1)
GTP12TXC_N: C655.2 C716.2 IC34.AD5(GTHE4_CHANNEL_X0Y8_2)
GTP12TXC_P: C656.2 C715.2 IC34.AD6(GTHE4_CHANNEL_X0Y8_3)
GTP13RXC_N: C649.2 C722.2 IC34.AC3(GTHE4_CHANNEL_X0Y9)
GTP13RXC_P: C650.2 C721.2 IC34.AC4(GTHE4_CHANNEL_X0Y9_1)
GTP13TXC_N: C657.2 C720.2 IC34.AC7(GTHE4_CHANNEL_X0Y9_2)
GTP13TXC_P: C658.2 C719.2 IC34.AC8(GTHE4_CHANNEL_X0Y9_3)
GTP14RXC_N: C651.2 C726.2 IC34.AB1(GTHE4_CHANNEL_X0Y10)
GTP14RXC_P: C652.2 C725.2 IC34.AB2(GTHE4_CHANNEL_X0Y10_1)
GTP14TXC_N: C659.2 C724.2 IC34.AB5(GTHE4_CHANNEL_X0Y10_2)
GTP14TXC_P: C660.2 C723.2 IC34.AB6(GTHE4_CHANNEL_X0Y10_3)
GTP15RXC_N: C653.2 C730.2 IC34.AA3(GTHE4_CHANNEL_X0Y11)
GTP15RXC_P: C654.2 C729.2 IC34.AA4(GTHE4_CHANNEL_X0Y11_1)
GTP15TXC_N: C661.2 C728.2 IC34.AA7(GTHE4_CHANNEL_X0Y11_2)
GTP15TXC_P: C662.2 C727.2 IC34.AA8(GTHE4_CHANNEL_X0Y11_3)
GTP_CLK0_IN_N: C623.2 IC34.W11(GTHE4_COMMON_X0Y4_2)
GTP_CLK0_IN_P: C624.2 IC34.W12(GTHE4_COMMON_X0Y4_3)
GTP_CLKC1_IN_N: C625.2 IC34.V9(GTHE4_COMMON_X0Y4_1)
GTP_CLKC1_IN_P: C626.2 IC34.V10(GTHE4_COMMON_X0Y4)
GTP_CLKC2_IN_N: C663.2 C665.2 IC34.AD9(GTHE4_COMMON_X0Y2_3)
GTP_CLKC2_IN_P: C664.2 C666.2 IC34.AD10(GTHE4_COMMON_X0Y2_2)
GTX_CLK_156.25C_N: C737.2 IC34.AB9(GTHE4_COMMON_X0Y2_1)
GTX_CLK_156.25C_P: C738.2 IC34.AB10(GTHE4_COMMON_X0Y2)
GTX_CLK_CUST1C_N: C741.2 IC34.AG11(GTHE4_COMMON_X0Y0)
GTX_CLK_CUST1C_P: C742.2 IC34.AG12(GTHE4_COMMON_X0Y0_1)
GTX_CLK_CUST2C_N: C735.2 IC34.AE11(GTHE4_COMMON_X0Y1)
GTX_CLK_CUST2C_P: C736.2 IC34.AE12(GTHE4_COMMON_X0Y1_1)
GTX_CLK_CUST3C_N: C645.2 IC34.Y9(GTHE4_COMMON_X0Y3_3)
GTX_CLK_CUST3C_P: C646.2 IC34.Y10(GTHE4_COMMON_X0Y3_2)
GTX_CLKC_125_N: C597.2 IC34.U11(GTHE4_COMMON_X0Y5_2)
GTX_CLKC_125_P: C598.2 IC34.U12(GTHE4_COMMON_X0Y5_3)
GTX_CLOCKS.GTX_CLK_125_N: C597.1
GTX_CLOCKS.GTX_CLK_125_P: C598.1
GTX_CLOCKS.GTX_CLK_156.25_N: C737.1
GTX_CLOCKS.GTX_CLK_156.25_P: C738.1
GTX_CLOCKS.GTX_CLK_CUST1_N: C741.1
GTX_CLOCKS.GTX_CLK_CUST1_P: C742.1
GTX_CLOCKS.GTX_CLK_CUST2_N: C735.1
GTX_CLOCKS.GTX_CLK_CUST2_P: C736.1
GTX_CLOCKS.GTX_CLK_CUST3_N: C645.1
GTX_CLOCKS.GTX_CLK_CUST3_P: C646.1
GTX_CLOCKS.GTX_CLK_CUST4_N: IC34.AF9(GTHE4_COMMON_X0Y1_3)
GTX_CLOCKS.GTX_CLK_CUST4_P: IC34.AF10(GTHE4_COMMON_X0Y1_2)
RTM_GTP.GTP0RX_N: C579.1
RTM_GTP.GTP0RX_P: C580.1
RTM_GTP.GTP0TX_N: C587.1
RTM_GTP.GTP0TX_P: C588.1
RTM_GTP.GTP1RX_N: C581.1
RTM_GTP.GTP1RX_P: C582.1
RTM_GTP.GTP1TX_N: C589.1
RTM_GTP.GTP1TX_P: C590.1
RTM_GTP.GTP2RX_N: C583.1
RTM_GTP.GTP2RX_P: C584.1
RTM_GTP.GTP2TX_N: C591.1
RTM_GTP.GTP2TX_P: C592.1
RTM_GTP.GTP3RX_N: C585.1
RTM_GTP.GTP3RX_P: C586.1
RTM_GTP.GTP3TX_N: C593.1
RTM_GTP.GTP3TX_P: C594.1
RTM_GTP.GTP4RX_N: C607.1
RTM_GTP.GTP4RX_P: C608.1
RTM_GTP.GTP4TX_N: C615.1
RTM_GTP.GTP4TX_P: C616.1
RTM_GTP.GTP5RX_N: C609.1
RTM_GTP.GTP5RX_P: C610.1
RTM_GTP.GTP5TX_N: C617.1
RTM_GTP.GTP5TX_P: C618.1
RTM_GTP.GTP6RX_N: C611.1
RTM_GTP.GTP6RX_P: C612.1
RTM_GTP.GTP6TX_N: C619.1
RTM_GTP.GTP6TX_P: C620.1
RTM_GTP.GTP7RX_N: C613.1
RTM_GTP.GTP7RX_P: C614.1
RTM_GTP.GTP7TX_N: C621.1
RTM_GTP.GTP7TX_P: C622.1
RTM_GTP.GTP8RX_N: C627.1
RTM_GTP.GTP8RX_P: C628.1
RTM_GTP.GTP8TX_N: C635.1
RTM_GTP.GTP8TX_P: C636.1
RTM_GTP.GTP9RX_N: C629.1
RTM_GTP.GTP9RX_P: C630.1
RTM_GTP.GTP9TX_N: C637.1
RTM_GTP.GTP9TX_P: C638.1
RTM_GTP.GTP10RX_N: C631.1
RTM_GTP.GTP10RX_P: C632.1
RTM_GTP.GTP10TX_N: C639.1
RTM_GTP.GTP10TX_P: C640.1
RTM_GTP.GTP11RX_N: C633.1
RTM_GTP.GTP11RX_P: C634.1
RTM_GTP.GTP11TX_N: C641.1
RTM_GTP.GTP11TX_P: C642.1
RTM_GTP.GTP12RX_N: C647.1
RTM_GTP.GTP12RX_P: C648.1
RTM_GTP.GTP12TX_N: C655.1
RTM_GTP.GTP12TX_P: C656.1
RTM_GTP.GTP13RX_N: C649.1
RTM_GTP.GTP13RX_P: C650.1
RTM_GTP.GTP13TX_N: C657.1
RTM_GTP.GTP13TX_P: C658.1
RTM_GTP.GTP14RX_N: C651.1
RTM_GTP.GTP14RX_P: C652.1
RTM_GTP.GTP14TX_N: C659.1
RTM_GTP.GTP14TX_P: C660.1
RTM_GTP.GTP15RX_N: C653.1
RTM_GTP.GTP15RX_P: C654.1
RTM_GTP.GTP15TX_N: C661.1
RTM_GTP.GTP15TX_P: C662.1
RTM_GTP.GTP_CLK1_IN_N: C623.1
RTM_GTP.GTP_CLK1_IN_P: C624.1
RTM_GTP.GTP_CLK2_IN_N: C663.1
RTM_GTP.GTP_CLK2_IN_P: C664.1
NetIC34_AC12: IC34.AC12(MGTRREF_R) R347.2

## Buses and harness runs
harness AMC_FABRIC_CLOCK = port AMC_FABRIC_CLOCK
harness AMC_P2P = port AMC_P2P
harness FAT_PIPE1 = port FAT_PIPE1
harness FAT_PIPE2 = port FAT_PIPE2
harness FMC1_DP = port FMC1_DP
harness FMC1_GBT_CLK = port FMC1_GBT_CLK
harness FMC2_DP = port FMC2_DP
harness FMC2_GBT_CLK = port FMC2_GBT_CLK
harness GTX_CLOCKS = port GTX_CLOCKS
harness RTM_GTP = port RTM_GTP

## Notes on the sheet
- not used
- GTX
- terms of the CERN OHL v.1.2.
- This documentation describes Open Hardware and is
- distributed WITHOUT ANY EXPRESS OR IMPLIED
- licensed under the CERN OHL v.1.2. You may
- (http://ohwr.org/CERNOHL). This documentation is
- redistribute and modify this documentation under the
- Copyright ISE WUT 2018.
- MERCHANTABILITY, SATISFACTORY QUALITY
- WARRANTY, INCLUDING OF
- conditions.
- AND FITNESS FOR A PARTICULAR PURPOSE.
- Please see the CERN OHL v.1.2 for applicable
- (in symbol R347) 1%